# EasyEDA Pro project Q's HelloWorld KeyBoard.eprj, board PCB 主体Type-C接口板
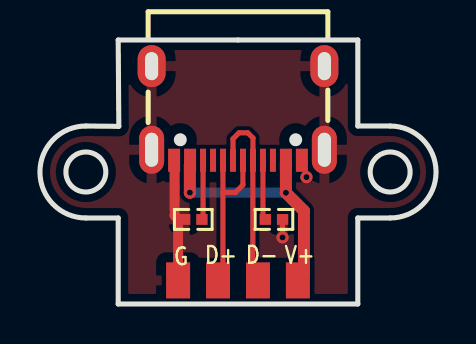
[diagram p13: board, top side]
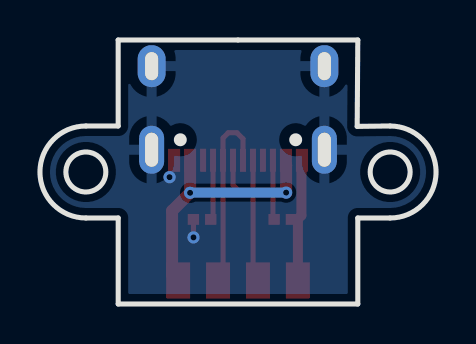
[diagram p14: board, bottom side, seen from below]

Outline 19.84 x 13.2 mm; copper layers: Top Layer, Bottom Layer. Coordinates in mm from the lower left corner of the outline.
Outline path: circle c2.3,6.6 r1 ; circle c17.54,6.6 r1 ; 2.3,8.9 3.95,8.88 3.92,13.2 15.92,13.2 15.92,8.9 17.54,8.9 arc(19.84,6.6) 17.54,4.3 15.92,4.3 15.92,0 3.92,0 3.92,4.3 2.3,4.3 arc(0,6.6) 2.3,8.9
Stack: Dielectric1 1.2mm FR4 er 4.5

## Design rules (mm)
spacing safeClearance (default): track to track 0.152, other pairs 0.152 to 0.3
track width trackWidth (default): min 0.127, default 0.254, max 2.54
differential pair differentialPair (default): width min 0.127, default 0.254, max 2.54; gap min 0.152, default 0.152
via viaSize (default): diameter min 0.5, default 0.61, max 10; hole min 0.3, default 0.305, max 6

## Placement (name value [footprint] x y rotation side)
CN1  1125-1104G0Z135CR01  [CONN-SMD_1125-1104G0Z135CR01]  9.92 1.18 180 top
R1  5.1kΩ  [R0402]  11.72 4.23 0 top
R2  5.1kΩ  [R0402]  7.68 4.23 0 top
USB2  TYPE-C-2.0-16PIN-SMT-3-OR  [USB-SMD_TYPE-C16PIN-1]  9.92 9.54 180 top

## Footprints (pads in the part's own frame, mm; a bottom-side part is the same pattern mirrored in y, then rotated)
CONN-SMD_1125-1104G0Z135CR01
  rect 1.2x1.8 smd: 1(-3,0) 2(-1,0) 3(1,0) 4(3,0)
R0402
  rect 0.566x0.54 smd: 1(-0.433,0) 2(0.433,0)
USB-SMD_TYPE-C16PIN-1
  oval 1.25x2.4 hole 0.65x1.7: 17(-4.325,1.827) 18(4.325,1.827)
  oval 1.4x2.1 hole 0.65x1.4: 19(-4.325,-2.353) 20(4.325,-2.353)
  rect 0.6x1.15 smd: A1B12(-3.2,2.353) A4B9(-2.4,2.353) B1A12(3.2,2.353) B4A9(2.4,2.353)
  rect 0.3x1.15 smd: A5(-1.25,2.353) A6(-0.25,2.353) A7(0.25,2.353) A8(1.25,2.353) B5(1.75,2.353) B6(0.75,2.353) B7(-0.75,2.353) B8(-1.75,2.353)

## Nets
As in the schematic.

Pads without a net: USB2 A8 B8

## Via types
v1: diameter 0.61, hole 0.305, Top Layer to Bottom Layer, 4 vias

## Routing (per net, layer and track width the routed paths; a pad name or vN(x,y) marks a point on that pad's centre or on a via; arc(x,y) is an arc through that point)
GND: length 6.7
  Top Layer w0.254: v1(12.15,3.33) 12.15,4.23 R1.2
  Top Layer w0.5: 6.74,6.92 6.74,4.42 6.92,4.25 CN1.4
  vias: v1(13.35,6.34)
VBUS: length 12.9
  Top Layer w0.254: 12.16,7.1 12.46,7.1
  Top Layer w0.6: v1(7.51,5.57) 7.51,6.94 7.51,6.95 ; 12.32,7.09 v1(12.32,5.56) 13.22,4.66 13.22,1.48 CN1.1
  Bottom Layer w0.5: v1(12.32,5.56) 12.31,5.57 v1(7.51,5.57)
CC1: length 3
  Top Layer w0.254: USB2.A5 11.17,4.35 R1.1
CC2: length 3
  Top Layer w0.254: R2.2 8.17,4.29 USB2.B5
DN: length 9.4
  Top Layer w0.254: USB2.A7 9.67,8.26 9.97,8.56 10.41,8.56 10.67,8.3 USB2.B7 ; 10.66,7.1 10.66,1.44 CN1.2
DP: length 8.3
  Top Layer w0.254: 9.16,5.57 9.16,1.42 CN1.3 ; 9.16,5.57 9.18,5.58 9.79,5.58 10.16,5.95 10.16,7.1 ; 9.16,5.57 9.16,7.1

## Copper pours and planes (outline as drawn; the poured copper is in the pictures)
GND on Top Layer: -1.08,14.33 20.95,14.33 20.95,-1.45 -1.08,-1.45
GND on Bottom Layer: -1.32,14.71 20.84,14.71 20.84,-1.69 -1.32,-1.69

## Text on the board
Document Layer: 板厚：1.2mm
Top Silkscreen Layer: G | D- | D+ | V+
